# EasyEDA Pro project kuafu01_030内部老化方案.eprj, board PCB4 (continued)
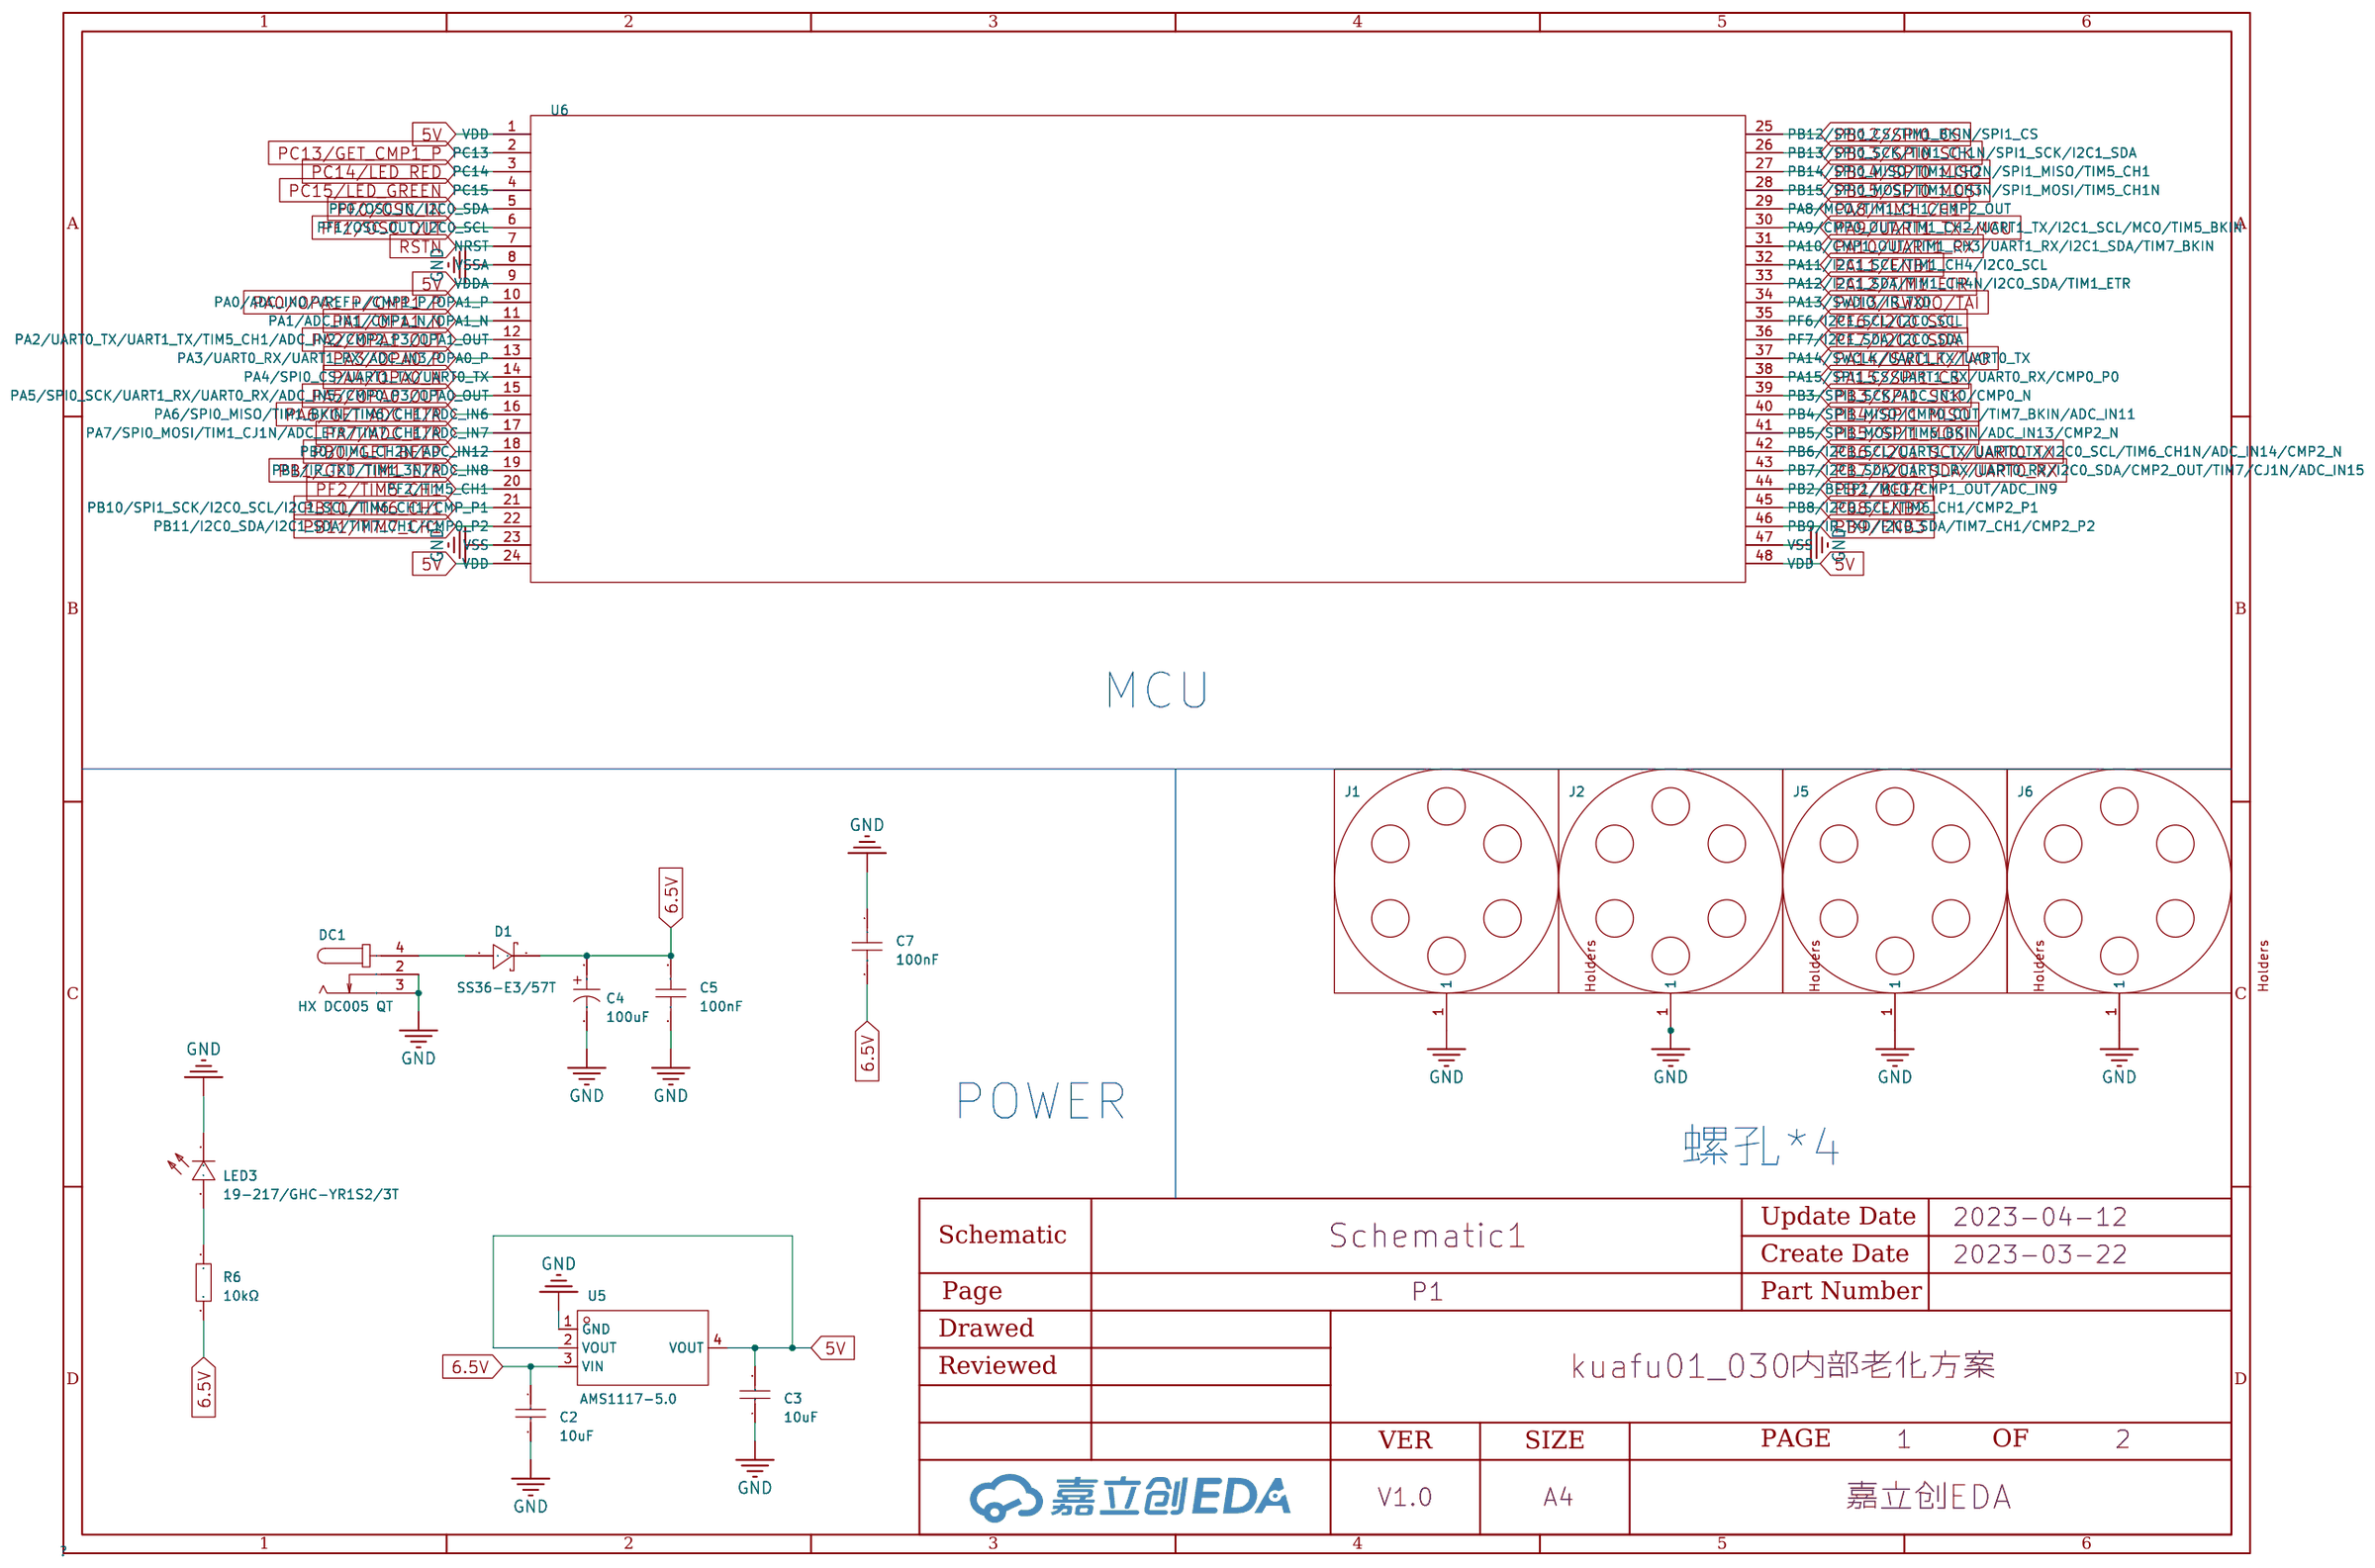
[diagram p0: P1]
## Routing (per net, layer and track width the routed paths; a pad name or vN(x,y) marks a point on that pad's centre or on a via; arc(x,y) is an arc through that point) (continued)
PB14/SPI0_MISO: length 1469.7
  Top Layer w0.254: 256.08,285.12 256.08,286.77 257.84,288.52 265.67,288.52 266.86,289.72 v1(267.56,289.72) ; v1(267.56,238.92) 266.86,238.92 265.67,237.72 257.84,237.72 256.08,235.97 256.08,234.32 ; 56.27,75.81 65.53,75.81 v1(67.19,77.47) ; v1(168.79,229.87) 167.13,228.21 157.87,228.21 ; 56.27,177.41 65.53,177.41 v1(67.19,179.07) ; v1(115.16,238.92) 114.46,238.92 113.27,237.72 105.44,237.72 103.68,235.97 103.68,234.32 ; 205.28,335.92 205.28,337.57 207.04,339.32 214.87,339.32 216.06,340.52 v1(216.76,340.52) ; v1(117.99,128.27) 116.33,126.61 107.07,126.61 ; 208.67,126.61 217.93,126.61 v1(219.59,128.27) ; 205.28,234.32 205.28,235.97 207.04,237.72 214.87,237.72 216.06,238.92 v1(216.76,238.92) ; 208.67,329.81 217.93,329.81 v1(219.59,331.47) ; 103.68,31.12 103.68,32.77 105.44,34.52 113.27,34.52 114.46,35.72 v1(115.16,35.72) ; v1(267.56,188.12) 266.86,188.12 265.67,186.92 257.84,186.92 256.08,185.17 256.08,183.52 ; 56.27,126.61 65.53,126.61 v1(67.19,128.27) ; v1(115.16,188.12) 114.46,188.12 113.27,186.92 105.44,186.92 103.68,185.17 103.68,183.52 ; v1(117.99,179.07) 116.33,177.41 107.07,177.41 ; v1(67.19,280.67) 65.53,279.01 56.27,279.01 ; 306.88,132.72 306.88,134.37 308.64,136.12 316.47,136.12 317.66,137.32 v1(318.36,137.32) ; v1(267.56,137.32) 266.86,137.32 265.67,136.12 257.84,136.12 256.08,134.37 256.08,132.72 ; v1(321.19,128.27) 319.53,126.61 310.27,126.61 ; 107.07,279.01 116.33,279.01 v1(117.99,280.67) ; 259.47,126.61 268.73,126.61 v1(270.39,128.27) ; v1(165.96,340.52) 165.26,340.52 164.07,339.32 156.24,339.32 154.48,337.57 154.48,335.92 ; v1(117.99,229.87) 116.33,228.21 107.07,228.21 ; 306.88,335.92 306.88,337.57 308.64,339.32 316.47,339.32 317.66,340.52 v1(318.36,340.52) ; v1(64.36,289.72) 63.66,289.72 62.47,288.52 54.64,288.52 52.88,286.77 52.88,285.12 ; v1(117.99,26.67) 116.33,25.01 107.07,25.01 ; 208.67,228.21 217.93,228.21 v1(219.59,229.87) ; v1(67.19,229.87) 65.53,228.21 56.27,228.21 ; 259.47,228.21 268.73,228.21 v1(270.39,229.87) ; v1(168.79,128.27) 167.13,126.61 157.87,126.61 ; 154.48,183.52 154.48,185.17 156.24,186.92 164.07,186.92 165.26,188.12 v1(165.96,188.12) ; v1(168.79,280.67) 167.13,279.01 157.87,279.01 ; 103.68,132.72 103.68,134.37 105.44,136.12 113.27,136.12 114.46,137.32 v1(115.16,137.32) ; 306.88,285.12 306.88,286.77 308.64,288.52 316.47,288.52 317.66,289.72 v1(318.36,289.72) ; v1(216.76,137.32) 216.06,137.32 214.87,136.12 207.04,136.12 205.28,134.37 205.28,132.72 ; 52.88,132.72 52.88,134.37 54.64,136.12 62.47,136.12 63.66,137.32 v1(64.36,137.32) ; 259.47,329.81 268.73,329.81 v1(270.39,331.47) ; 259.47,25.01 268.73,25.01 v1(270.39,26.67) ; 157.87,75.81 167.13,75.81 v1(168.79,77.47) ; v1(115.16,340.52) 114.46,340.52 113.27,339.32 105.44,339.32 103.68,337.57 103.68,335.92 ; v1(117.99,331.47) 116.33,329.81 107.07,329.81 ; 157.87,329.81 167.13,329.81 v1(168.79,331.47) ; 256.08,81.92 256.08,83.57 257.84,85.32 265.67,85.32 266.86,86.52 v1(267.56,86.52) ; v1(216.76,86.52) 216.06,86.52 214.87,85.32 207.04,85.32 205.28,83.57 205.28,81.92 ; v1(168.79,179.07) 167.13,177.41 157.87,177.41 ; 256.08,335.92 256.08,337.57 257.84,339.32 265.67,339.32 266.86,340.52 v1(267.56,340.52) ; v1(216.76,289.72) 216.06,289.72 214.87,288.52 207.04,288.52 205.28,286.77 205.28,285.12 ; 310.27,279.01 319.53,279.01 v1(321.19,280.67) ; 157.87,25.01 167.13,25.01 v1(168.79,26.67) ; v1(64.36,238.92) 63.66,238.92 62.47,237.72 54.64,237.72 52.88,235.97 52.88,234.32 ; 154.48,132.72 154.48,134.37 156.24,136.12 164.07,136.12 165.26,137.32 v1(165.96,137.32) ; v1(67.19,26.67) 65.53,25.01 56.27,25.01 ; 256.08,31.12 256.08,32.77 257.84,34.52 265.67,34.52 266.86,35.72 v1(267.56,35.72) ; 310.27,75.81 319.53,75.81 v1(321.19,77.47) ; v1(64.36,86.52) 63.66,86.52 62.47,85.32 54.64,85.32 52.88,83.57 52.88,81.92 ; 259.47,75.81 268.73,75.81 v1(270.39,77.47) ; 208.67,177.41 217.93,177.41 v1(219.59,179.07) ; 107.07,75.81 116.33,75.81 v1(117.99,77.47) ; v1(318.36,86.52) 317.66,86.52 316.47,85.32 308.64,85.32 306.88,83.57 306.88,81.92 ; 154.48,234.32 154.48,235.97 156.24,237.72 164.07,237.72 165.26,238.92 v1(165.96,238.92) ; v1(219.59,26.67) 217.93,25.01 208.67,25.01 ; v1(318.36,238.92) 317.66,238.92 316.47,237.72 308.64,237.72 306.88,235.97 306.88,234.32 ; v1(219.59,77.47) 217.93,75.81 208.67,75.81 ; v1(165.96,289.72) 165.26,289.72 164.07,288.52 156.24,288.52 154.48,286.77 154.48,285.12 ; 310.27,177.41 319.53,177.41 v1(321.19,179.07) ; v1(216.76,35.72) 216.06,35.72 214.87,34.52 207.04,34.52 205.28,32.77 205.28,31.12 ; 52.88,183.52 52.88,185.17 54.64,186.92 62.47,186.92 63.66,188.12 v1(64.36,188.12) ; 310.27,228.21 319.53,228.21 v1(321.19,229.87) ; 154.48,81.92 154.48,83.57 156.24,85.32 164.07,85.32 165.26,86.52 v1(165.96,86.52) ; 205.28,183.52 205.28,185.17 207.04,186.92 214.87,186.92 216.06,188.12 v1(216.76,188.12) ; 306.88,183.52 306.88,185.17 308.64,186.92 316.47,186.92 317.66,188.12 v1(318.36,188.12) ; v1(321.19,331.47) 319.53,329.81 310.27,329.81 ; 259.47,279.01 268.73,279.01 v1(270.39,280.67) ; v1(64.36,35.72) 63.66,35.72 62.47,34.52 54.64,34.52 52.88,32.77 52.88,31.12 ; v1(219.59,280.67) 217.93,279.01 208.67,279.01 ; v1(165.96,35.72) 165.26,35.72 164.07,34.52 156.24,34.52 154.48,32.77 154.48,31.12 ; v1(115.16,86.52) 114.46,86.52 113.27,85.32 105.44,85.32 103.68,83.57 103.68,81.92 ; v1(115.16,289.72) 114.46,289.72 113.27,288.52 105.44,288.52 103.68,286.77 103.68,285.12 ; v1(270.39,179.07) 268.73,177.41 259.47,177.41
  Bottom Layer w0.254: v1(219.59,229.87) 219.85,230.12 219.85,236.44 217.37,238.92 v1(216.76,238.92) ; v1(267.56,188.12) 268.17,188.12 270.65,185.64 270.65,179.32 v1(270.39,179.07) ; v1(270.39,229.87) 270.65,230.12 270.65,236.44 268.17,238.92 v1(267.56,238.92) ; v1(64.36,238.92) 64.97,238.92 67.45,236.44 67.45,230.12 v1(67.19,229.87) ; v1(216.76,137.32) 217.37,137.32 219.85,134.84 219.85,128.52 v1(219.59,128.27) ; v1(216.76,340.52) 217.37,340.52 219.85,338.04 219.85,331.72 v1(219.59,331.47) ; v1(117.99,77.47) 118.25,77.72 118.25,84.04 115.77,86.52 v1(115.16,86.52) ; v1(321.19,229.87) 321.45,230.12 321.45,236.44 318.97,238.92 v1(318.36,238.92) ; v1(219.59,280.67) 219.85,280.92 219.85,287.24 217.37,289.72 v1(216.76,289.72) ; v1(270.39,77.47) 270.65,77.72 270.65,84.04 268.17,86.52 v1(267.56,86.52) ; v1(165.96,35.72) 166.57,35.72 169.05,33.24 169.05,26.92 v1(168.79,26.67) ; v1(117.99,229.87) 118.25,230.12 118.25,236.44 115.77,238.92 v1(115.16,238.92) ; v1(115.16,289.72) 115.77,289.72 118.25,287.24 118.25,280.92 v1(117.99,280.67) ; v1(219.59,77.47) 219.85,77.72 219.85,84.04 217.37,86.52 v1(216.76,86.52) ; v1(67.19,179.07) 67.45,179.32 67.45,185.64 64.97,188.12 v1(64.36,188.12) ; v1(270.39,331.47) 270.65,331.72 270.65,338.04 268.17,340.52 v1(267.56,340.52) ; v1(165.96,137.32) 166.57,137.32 169.05,134.84 169.05,128.52 v1(168.79,128.27) ; v1(64.36,137.32) 64.97,137.32 67.45,134.84 67.45,128.52 v1(67.19,128.27) ; v1(168.79,229.87) 169.05,230.12 169.05,236.44 166.57,238.92 v1(165.96,238.92) ; v1(67.19,77.47) 67.45,77.72 67.45,84.04 64.97,86.52 v1(64.36,86.52) ; v1(219.59,26.67) 219.85,26.92 219.85,33.24 217.37,35.72 v1(216.76,35.72) ; v1(270.39,128.27) 270.65,128.52 270.65,134.84 268.17,137.32 v1(267.56,137.32) ; v1(318.36,86.52) 318.97,86.52 321.45,84.04 321.45,77.72 v1(321.19,77.47) ; v1(321.19,331.47) 321.45,331.72 321.45,338.04 318.97,340.52 v1(318.36,340.52) ; v1(117.99,128.27) 118.25,128.52 118.25,134.84 115.77,137.32 v1(115.16,137.32) ; v1(115.16,340.52) 115.77,340.52 118.25,338.04 118.25,331.72 v1(117.99,331.47) ; v1(168.79,280.67) 169.05,280.92 169.05,287.24 166.57,289.72 v1(165.96,289.72) ; v1(67.19,280.67) 67.45,280.92 67.45,287.24 64.97,289.72 v1(64.36,289.72) ; v1(168.79,179.07) 169.05,179.32 169.05,185.64 166.57,188.12 v1(165.96,188.12) ; v1(117.99,179.07) 118.25,179.32 118.25,185.64 115.77,188.12 v1(115.16,188.12) ; v1(321.19,128.27) 321.45,128.52 321.45,134.84 318.97,137.32 v1(318.36,137.32) ; v1(219.59,179.07) 219.85,179.32 219.85,185.64 217.37,188.12 v1(216.76,188.12) ; v1(64.36,35.72) 64.97,35.72 67.45,33.24 67.45,26.92 v1(67.19,26.67) ; v1(165.96,86.52) 166.57,86.52 169.05,84.04 169.05,77.72 v1(168.79,77.47) ; v1(117.99,26.67) 118.25,26.92 118.25,33.24 115.77,35.72 v1(115.16,35.72) ; v1(165.96,340.52) 166.57,340.52 169.05,338.04 169.05,331.72 v1(168.79,331.47) ; v1(318.36,188.12) 318.97,188.12 321.45,185.64 321.45,179.32 v1(321.19,179.07) ; v1(267.56,289.72) 268.17,289.72 270.65,287.24 270.65,280.92 v1(270.39,280.67) ; v1(267.56,35.72) 268.17,35.72 270.65,33.24 270.65,26.92 v1(270.39,26.67) ; v1(321.19,280.67) 321.45,280.92 321.45,287.24 318.97,289.72 v1(318.36,289.72)
PB15/SPI0_MOSI: length 1402.3
  Top Layer w0.254: 52.36,132.87 52.36,134.41 54.64,136.7 60.54,136.7 61.21,137.37 v1(62.56,137.37) ; v1(316.56,340.57) 315.21,340.57 314.54,339.9 308.64,339.9 306.36,337.61 306.36,336.07 ; v1(218.98,230.51) 218.98,230.25 217.43,228.7 208.24,228.7 ; v1(265.76,188.17) 264.41,188.17 263.74,187.5 257.84,187.5 255.56,185.21 255.56,183.67 ; 255.56,285.27 255.56,286.81 257.84,289.1 263.74,289.1 264.41,289.77 v1(265.76,289.77) ; 204.76,132.87 204.76,134.41 207.04,136.7 212.94,136.7 213.61,137.37 v1(214.96,137.37) ; v1(320.58,128.91) 320.58,128.65 319.03,127.1 309.84,127.1 ; 204.76,285.27 204.76,286.81 207.04,289.1 212.94,289.1 213.61,289.77 v1(214.96,289.77) ; v1(164.16,238.97) 162.81,238.97 162.14,238.3 156.24,238.3 153.96,236.01 153.96,234.47 ; v1(269.78,281.31) 269.78,281.05 268.23,279.5 259.04,279.5 ; 255.56,336.07 255.56,337.61 257.84,339.9 263.74,339.9 264.41,340.57 v1(265.76,340.57) ; 157.44,177.9 166.63,177.9 168.18,179.45 v1(168.18,179.71) ; v1(113.36,238.97) 112.01,238.97 111.34,238.3 105.44,238.3 103.16,236.01 103.16,234.47 ; v1(269.78,27.31) 269.78,27.05 268.23,25.5 259.04,25.5 ; v1(117.38,332.11) 117.38,331.85 115.83,330.3 106.64,330.3 ; v1(62.56,86.57) 61.21,86.57 60.54,85.9 54.64,85.9 52.36,83.61 52.36,82.07 ; 204.76,183.67 204.76,185.21 207.04,187.5 212.94,187.5 213.61,188.17 v1(214.96,188.17) ; 259.04,177.9 268.23,177.9 269.78,179.45 v1(269.78,179.71) ; 106.64,76.3 115.83,76.3 117.38,77.85 v1(117.38,78.11) ; v1(66.58,230.51) 66.58,230.25 65.03,228.7 55.84,228.7 ; 309.84,177.9 319.03,177.9 320.58,179.45 v1(320.58,179.71) ; 103.16,285.27 103.16,286.81 105.44,289.1 111.34,289.1 112.01,289.77 v1(113.36,289.77) ; 153.96,285.27 153.96,286.81 156.24,289.1 162.14,289.1 162.81,289.77 v1(164.16,289.77) ; 55.84,76.3 65.03,76.3 66.58,77.85 v1(66.58,78.11) ; 103.16,183.67 103.16,185.21 105.44,187.5 111.34,187.5 112.01,188.17 v1(113.36,188.17) ; v1(269.78,128.91) 269.78,128.65 268.23,127.1 259.04,127.1 ; 204.76,82.07 204.76,83.61 207.04,85.9 212.94,85.9 213.61,86.57 v1(214.96,86.57) ; 103.16,336.07 103.16,337.61 105.44,339.9 111.34,339.9 112.01,340.57 v1(113.36,340.57) ; v1(218.98,281.31) 218.98,281.05 217.43,279.5 208.24,279.5 ; v1(117.38,128.91) 117.38,128.65 115.83,127.1 106.64,127.1 ; 55.84,25.5 65.03,25.5 66.58,27.05 v1(66.58,27.31) ; 208.24,330.3 217.43,330.3 218.98,331.85 v1(218.98,332.11) ; v1(316.56,238.97) 315.21,238.97 314.54,238.3 308.64,238.3 306.36,236.01 306.36,234.47 ; v1(218.98,27.31) 218.98,27.05 217.43,25.5 208.24,25.5 ; v1(62.56,238.97) 61.21,238.97 60.54,238.3 54.64,238.3 52.36,236.01 52.36,234.47 ; 157.44,76.3 166.63,76.3 168.18,77.85 v1(168.18,78.11) ; 309.84,330.3 319.03,330.3 320.58,331.85 v1(320.58,332.11) ; v1(265.76,238.97) 264.41,238.97 263.74,238.3 257.84,238.3 255.56,236.01 255.56,234.47 ; 309.84,228.7 319.03,228.7 320.58,230.25 v1(320.58,230.51) ; 106.64,177.9 115.83,177.9 117.38,179.45 v1(117.38,179.71) ; v1(66.58,128.91) 66.58,128.65 65.03,127.1 55.84,127.1 ; v1(218.98,128.91) 218.98,128.65 217.43,127.1 208.24,127.1 ; 157.44,228.7 166.63,228.7 168.18,230.25 v1(168.18,230.51) ; v1(269.78,78.11) 269.78,77.85 268.23,76.3 259.04,76.3 ; 52.36,31.27 52.36,32.81 54.64,35.1 60.54,35.1 61.21,35.77 v1(62.56,35.77) ; 103.16,132.87 103.16,134.41 105.44,136.7 111.34,136.7 112.01,137.37 v1(113.36,137.37) ; 204.76,336.07 204.76,337.61 207.04,339.9 212.94,339.9 213.61,340.57 v1(214.96,340.57) ; v1(117.38,281.31) 117.38,281.05 115.83,279.5 106.64,279.5 ; 103.16,31.27 103.16,32.81 105.44,35.1 111.34,35.1 112.01,35.77 v1(113.36,35.77) ; v1(316.56,86.57) 315.21,86.57 314.54,85.9 308.64,85.9 306.36,83.61 306.36,82.07 ; v1(269.78,332.11) 269.78,331.85 268.23,330.3 259.04,330.3 ; v1(316.56,188.17) 315.21,188.17 314.54,187.5 308.64,187.5 306.36,185.21 306.36,183.67 ; v1(117.38,27.31) 117.38,27.05 115.83,25.5 106.64,25.5 ; v1(168.18,128.91) 168.18,128.65 166.63,127.1 157.44,127.1 ; v1(117.38,230.51) 117.38,230.25 115.83,228.7 106.64,228.7 ; v1(62.56,188.17) 61.21,188.17 60.54,187.5 54.64,187.5 52.36,185.21 52.36,183.67 ; 55.84,279.5 65.03,279.5 66.58,281.05 v1(66.58,281.31) ; 157.44,279.5 166.63,279.5 168.18,281.05 v1(168.18,281.31) ; 255.56,82.07 255.56,83.61 257.84,85.9 263.74,85.9 264.41,86.57 v1(265.76,86.57) ; v1(214.96,238.97) 213.61,238.97 212.94,238.3 207.04,238.3 204.76,236.01 204.76,234.47 ; 259.04,228.7 268.23,228.7 269.78,230.25 v1(269.78,230.51) ; v1(218.98,179.71) 218.98,179.45 217.43,177.9 208.24,177.9 ; v1(164.16,86.57) 162.81,86.57 162.14,85.9 156.24,85.9 153.96,83.61 153.96,82.07 ; v1(214.96,35.77) 213.61,35.77 212.94,35.1 207.04,35.1 204.76,32.81 204.76,31.27 ; 52.36,285.27 52.36,286.81 54.64,289.1 60.54,289.1 61.21,289.77 v1(62.56,289.77) ; v1(164.16,35.77) 162.81,35.77 162.14,35.1 156.24,35.1 153.96,32.81 153.96,31.27 ; 309.84,279.5 319.03,279.5 320.58,281.05 v1(320.58,281.31) ; v1(316.56,289.77) 315.21,289.77 314.54,289.1 308.64,289.1 306.36,286.81 306.36,285.27 ; 153.96,132.87 153.96,134.41 156.24,136.7 162.14,136.7 162.81,137.37 v1(164.16,137.37) ; 103.16,82.07 103.16,83.61 105.44,85.9 111.34,85.9 112.01,86.57 v1(113.36,86.57) ; 153.96,183.67 153.96,185.21 156.24,187.5 162.14,187.5 162.81,188.17 v1(164.16,188.17) ; v1(218.98,78.11) 218.98,77.85 217.43,76.3 208.24,76.3 ; v1(320.58,78.11) 320.58,77.85 319.03,76.3 309.84,76.3 ; 306.36,132.87 306.36,134.41 308.64,136.7 314.54,136.7 315.21,137.37 v1(316.56,137.37) ; v1(265.76,35.77) 264.41,35.77 263.74,35.1 257.84,35.1 255.56,32.81 255.56,31.27 ; v1(265.76,137.37) 264.41,137.37 263.74,136.7 257.84,136.7 255.56,134.41 255.56,132.87 ; 55.84,177.9 65.03,177.9 66.58,179.45 v1(66.58,179.71) ; v1(168.18,27.31) 168.18,27.05 166.63,25.5 157.44,25.5 ; 157.44,330.3 166.63,330.3 168.18,331.85 v1(168.18,332.11) ; v1(164.16,340.57) 162.81,340.57 162.14,339.9 156.24,339.9 153.96,337.61 153.96,336.07
  Bottom Layer w0.254: v1(316.56,188.17) 317.11,188.17 320.55,184.73 320.55,179.73 v1(320.58,179.71) ; v1(316.56,340.57) 317.11,340.57 320.55,337.13 320.55,332.13 v1(320.58,332.11) ; v1(218.98,281.31) 218.95,281.33 218.95,286.33 215.51,289.77 v1(214.96,289.77) ; v1(218.98,230.51) 218.95,230.53 218.95,235.53 215.51,238.97 v1(214.96,238.97) ; v1(265.76,86.57) 266.31,86.57 269.75,83.13 269.75,78.13 v1(269.78,78.11) ; v1(269.78,27.31) 269.75,27.33 269.75,32.33 266.31,35.77 v1(265.76,35.77) ; v1(316.56,86.57) 317.11,86.57 320.55,83.13 320.55,78.13 v1(320.58,78.11) ; v1(265.76,238.97) 266.31,238.97 269.75,235.53 269.75,230.53 v1(269.78,230.51) ; v1(66.58,230.51) 66.55,230.53 66.55,235.53 63.11,238.97 v1(62.56,238.97) ; v1(168.18,27.31) 168.15,27.33 168.15,32.33 164.71,35.77 v1(164.16,35.77) ; v1(316.56,289.77) 317.11,289.77 320.55,286.33 320.55,281.33 v1(320.58,281.31) ; v1(164.16,238.97) 164.71,238.97 168.15,235.53 168.15,230.53 v1(168.18,230.51) ; v1(218.98,78.11) 218.95,78.13 218.95,83.13 215.51,86.57 v1(214.96,86.57) ; v1(269.78,281.31) 269.75,281.33 269.75,286.33 266.31,289.77 v1(265.76,289.77) ; v1(168.18,179.71) 168.15,179.73 168.15,184.73 164.71,188.17 v1(164.16,188.17) ; v1(113.36,137.37) 113.91,137.37 117.35,133.93 117.35,128.93 v1(117.38,128.91) ; v1(320.58,128.91) 320.55,128.93 320.55,133.93 317.11,137.37 v1(316.56,137.37) ; v1(218.98,27.31) 218.95,27.33 218.95,32.33 215.51,35.77 v1(214.96,35.77) ; v1(269.78,332.11) 269.75,332.13 269.75,337.13 266.31,340.57 v1(265.76,340.57) ; v1(113.36,188.17) 113.91,188.17 117.35,184.73 117.35,179.73 v1(117.38,179.71) ; v1(265.76,137.37) 266.31,137.37 269.75,133.93 269.75,128.93 v1(269.78,128.91) ; v1(164.16,137.37) 164.71,137.37 168.15,133.93 168.15,128.93 v1(168.18,128.91) ; v1(164.16,289.77) 164.71,289.77 168.15,286.33 168.15,281.33 v1(168.18,281.31) ; v1(316.56,238.97) 317.11,238.97 320.55,235.53 320.55,230.53 v1(320.58,230.51) ; v1(164.16,86.57) 164.71,86.57 168.15,83.13 168.15,78.13 v1(168.18,78.11) ; v1(117.38,230.51) 117.35,230.53 117.35,235.53 113.91,238.97 v1(113.36,238.97) ; v1(218.98,128.91) 218.95,128.93 218.95,133.93 215.51,137.37 v1(214.96,137.37) ; v1(117.38,78.11) 117.35,78.13 117.35,83.13 113.91,86.57 v1(113.36,86.57) ; v1(113.36,35.77) 113.91,35.77 117.35,32.33 117.35,27.33 v1(117.38,27.31) ; v1(117.38,332.11) 117.35,332.13 117.35,337.13 113.91,340.57 v1(113.36,340.57) ; v1(62.56,188.17) 63.11,188.17 66.55,184.73 66.55,179.73 v1(66.58,179.71) ; v1(66.58,78.11) 66.55,78.13 66.55,83.13 63.11,86.57 v1(62.56,86.57) ; v1(62.56,289.77) 63.11,289.77 66.55,286.33 66.55,281.33 v1(66.58,281.31) ; v1(218.98,179.71) 218.95,179.73 218.95,184.73 215.51,188.17 v1(214.96,188.17) ; v1(164.16,340.57) 164.71,340.57 168.15,337.13 168.15,332.13 v1(168.18,332.11) ; v1(62.56,35.77) 63.11,35.77 66.55,32.33 66.55,27.33 v1(66.58,27.31) ; v1(117.38,281.31) 117.35,281.33 117.35,286.33 113.91,289.77 v1(113.36,289.77) ; v1(218.98,332.11) 218.95,332.13 218.95,337.13 215.51,340.57 v1(214.96,340.57) ; v1(269.78,179.71) 269.75,179.73 269.75,184.73 266.31,188.17 v1(265.76,188.17) ; v1(66.58,128.91) 66.55,128.93 66.55,133.93 63.11,137.37 v1(62.56,137.37)
PC13/GET_CMP1_P: length 1482.3
  Top Layer w0.254: 137.84,222 135.75,222 133.64,224.1 133.64,237.59 134.7,238.65 141.52,238.65 147.97,232.2 U6#5.2 ; 36.24,272.8 34.15,272.8 32.04,274.9 32.04,288.39 33.1,289.45 39.92,289.45 46.36,283 U6#37.2 ; 188.64,272.8 186.55,272.8 184.44,274.9 184.44,288.39 185.5,289.45 192.32,289.45 198.77,283 199.83,283 ; 137.84,272.8 135.75,272.8 133.64,274.9 133.64,288.39 134.7,289.45 141.52,289.45 147.97,283 U6#39.2 ; U6#27.2 46.36,29 39.92,35.45 33.1,35.45 32.04,34.39 32.04,20.9 34.15,18.8 36.24,18.8 ; U6#13.2 249.56,181.4 243.12,187.85 236.3,187.85 235.24,186.79 235.24,173.3 237.35,171.2 239.44,171.2 ; U6#4.2 97.16,232.2 90.72,238.65 83.9,238.65 82.84,237.59 82.84,224.1 84.95,222 87.04,222 ; 239.44,18.8 237.35,18.8 235.24,20.9 235.24,34.39 236.3,35.45 243.12,35.45 249.56,29 U6#31.2 ; 239.44,272.8 237.35,272.8 235.24,274.9 235.24,288.39 236.3,289.45 243.12,289.45 249.56,283 U6.2 ; 290.24,222 288.15,222 286.04,224.1 286.04,237.59 287.1,238.65 293.92,238.65 300.37,232.2 U6#8.2 ; 137.84,120.4 135.75,120.4 133.64,122.5 133.64,135.99 134.7,137.05 141.52,137.05 147.97,130.6 U6#17.2 ; 199.83,181.4 198.77,181.4 192.32,187.85 185.5,187.85 184.44,186.79 184.44,173.3 186.55,171.2 188.64,171.2 ; U6#19.2 249.56,130.6 243.12,137.05 236.3,137.05 235.24,135.99 235.24,122.5 237.35,120.4 239.44,120.4 ; U6#15.2 46.36,130.6 39.92,137.05 33.1,137.05 32.04,135.99 32.04,122.5 34.15,120.4 36.24,120.4 ; U6#38.2 97.16,283 90.72,289.45 83.9,289.45 82.84,288.39 82.84,274.9 84.95,272.8 87.04,272.8 ; U6#20.2 300.37,130.6 293.92,137.05 287.1,137.05 286.04,135.99 286.04,122.5 288.15,120.4 290.24,120.4 ; U6#29.2 147.97,29 141.52,35.45 134.7,35.45 133.64,34.39 133.64,20.9 135.75,18.8 137.84,18.8 ; 290.24,323.6 288.15,323.6 286.04,325.7 286.04,339.19 287.1,340.25 293.92,340.25 300.37,333.8 U6#36.2 ; 137.84,171.2 135.75,171.2 133.64,173.3 133.64,186.79 134.7,187.85 141.52,187.85 147.97,181.4 U6#11.2 ; 239.44,69.6 237.35,69.6 235.24,71.7 235.24,85.19 236.3,86.25 243.12,86.25 249.56,79.8 U6#25.2 ; 239.44,323.6 237.35,323.6 235.24,325.7 235.24,339.19 236.3,340.25 243.12,340.25 249.56,333.8 U6#35.2 ; 87.04,69.6 84.95,69.6 82.84,71.7 82.84,85.19 83.9,86.25 90.72,86.25 97.16,79.8 U6#22.2 ; U6#3.2 46.36,232.2 39.92,238.65 33.1,238.65 32.04,237.59 32.04,224.1 34.15,222 36.24,222 ; 87.04,18.8 84.95,18.8 82.84,20.9 82.84,34.39 83.9,35.45 90.72,35.45 97.16,29 U6#28.2 ; 137.84,69.6 135.75,69.6 133.64,71.7 133.64,85.19 134.7,86.25 141.52,86.25 147.97,79.8 U6#23.2 ; U6#32.2 97.16,333.8 90.72,340.25 83.9,340.25 82.84,339.19 82.84,325.7 84.95,323.6 87.04,323.6 ; U6#16.2 97.16,130.6 90.72,137.05 83.9,137.05 82.84,135.99 82.84,122.5 84.95,120.4 87.04,120.4 ; 290.24,69.6 288.15,69.6 286.04,71.7 286.04,85.19 287.1,86.25 293.92,86.25 300.37,79.8 U6#26.2 ; U6#9.2 46.36,181.4 39.92,187.85 33.1,187.85 32.04,186.79 32.04,173.3 34.15,171.2 36.24,171.2 ; 188.64,69.6 186.55,69.6 184.44,71.7 184.44,85.19 185.5,86.25 192.32,86.25 198.77,79.8 199.83,79.8 ; 137.84,323.6 135.75,323.6 133.64,325.7 133.64,339.19 134.7,340.25 141.52,340.25 147.97,333.8 U6#33.2 ; 199.83,232.2 198.77,232.2 192.32,238.65 185.5,238.65 184.44,237.59 184.44,224.1 186.55,222 188.64,222 ; 290.24,171.2 288.15,171.2 286.04,173.3 286.04,186.79 287.1,187.85 293.92,187.85 300.37,181.4 U6#14.2 ; 36.24,69.6 34.15,69.6 32.04,71.7 32.04,85.19 33.1,86.25 39.92,86.25 46.36,79.8 U6#21.2 ; U6#2.2 300.37,283 293.92,289.45 287.1,289.45 286.04,288.39 286.04,274.9 288.15,272.8 290.24,272.8 ; 188.64,120.4 186.55,120.4 184.44,122.5 184.44,135.99 185.5,137.05 192.32,137.05 198.77,130.6 199.83,130.6 ; U6#7.2 249.56,232.2 243.12,238.65 236.3,238.65 235.24,237.59 235.24,224.1 237.35,222 239.44,222 ; 188.64,323.6 186.55,323.6 184.44,325.7 184.44,339.19 185.5,340.25 192.32,340.25 198.77,333.8 199.83,333.8 ; 188.64,18.8 186.55,18.8 184.44,20.9 184.44,34.39 185.5,35.45 192.32,35.45 198.77,29 199.83,29 ; U6#10.2 97.16,181.4 90.72,187.85 83.9,187.85 82.84,186.79 82.84,173.3 84.95,171.2 87.04,171.2
PC14/LED_RED: length 400.4
  Top Layer w0.254: 47.43,231.7 46.29,231.7 40.55,237.44 39.8,237.44 39.8,237.44 ; 199.83,282.5 198.69,282.5 192.95,288.24 192.2,288.24 192.2,288.25 ; 293.8,288.25 293.8,288.24 294.55,288.24 300.29,282.5 301.43,282.5 ; 250.63,282.5 249.49,282.5 243.75,288.24 243,288.24 243,288.25 ; 98.23,28.5 97.09,28.5 91.35,34.24 90.6,34.24 90.6,34.25 ; 47.43,130.1 46.29,130.1 40.55,135.84 39.8,135.84 39.8,135.84 ; 149.03,79.3 147.89,79.3 142.15,85.04 141.4,85.04 141.4,85.04 ; 192.2,186.64 192.2,186.64 192.95,186.64 198.69,180.9 199.83,180.9 ; 98.23,180.9 97.09,180.9 91.35,186.64 90.6,186.64 90.6,186.64 ; 90.6,85.04 90.6,85.04 91.35,85.04 97.09,79.3 98.23,79.3 ; 39.8,288.25 39.8,288.24 40.55,288.24 46.29,282.5 47.43,282.5 ; 293.8,135.84 293.8,135.84 294.55,135.84 300.29,130.1 301.43,130.1 ; 301.43,333.3 300.29,333.3 294.55,339.04 293.8,339.04 293.8,339.04 ; 250.63,28.5 249.49,28.5 243.75,34.24 243,34.24 243,34.25 ; 47.43,180.9 46.29,180.9 40.55,186.64 39.8,186.64 39.8,186.64 ; 98.23,231.7 97.09,231.7 91.35,237.44 90.6,237.44 90.6,237.44 ; 293.8,186.64 293.8,186.64 294.55,186.64 300.29,180.9 301.43,180.9 ; 141.4,237.44 141.4,237.44 142.15,237.44 147.89,231.7 149.03,231.7 ; 98.23,282.5 97.09,282.5 91.35,288.24 90.6,288.24 90.6,288.25 ; 141.4,288.25 141.4,288.24 142.15,288.24 147.89,282.5 149.03,282.5 ; 293.8,85.04 293.8,85.04 294.55,85.04 300.29,79.3 301.43,79.3 ; 149.03,130.1 147.89,130.1 142.15,135.84 141.4,135.84 141.4,135.84 ; 199.83,231.7 198.69,231.7 192.95,237.44 192.2,237.44 192.2,237.44 ; 250.63,231.7 249.49,231.7 243.75,237.44 243,237.44 243,237.44 ; 199.83,130.1 198.69,130.1 192.95,135.84 192.2,135.84 192.2,135.84 ; 39.8,85.04 39.8,85.04 40.55,85.04 46.29,79.3 47.43,79.3 ; 47.43,28.5 46.29,28.5 40.55,34.24 39.8,34.24 39.8,34.25 ; 149.03,28.5 147.89,28.5 142.15,34.24 141.4,34.24 141.4,34.25 ; 192.2,339.04 192.2,339.04 192.95,339.04 198.69,333.3 199.83,333.3 ; 243,186.64 243,186.64 243.75,186.64 249.49,180.9 250.63,180.9 ; 149.03,180.9 147.89,180.9 142.15,186.64 141.4,186.64 141.4,186.64 ; 149.03,333.3 147.89,333.3 142.15,339.04 141.4,339.04 141.4,339.04 ; 250.63,130.1 249.49,130.1 243.75,135.84 243,135.84 243,135.84 ; 301.43,231.7 300.29,231.7 294.55,237.44 293.8,237.44 293.8,237.44 ; 199.83,28.5 198.69,28.5 192.95,34.24 192.2,34.24 192.2,34.25 ; 250.63,333.3 249.49,333.3 243.75,339.04 243,339.04 243,339.04 ; 98.23,333.3 97.09,333.3 91.35,339.04 90.6,339.04 90.6,339.04 ; 90.6,135.84 90.6,135.84 91.35,135.84 97.09,130.1 98.23,130.1 ; 192.2,85.04 192.2,85.04 192.95,85.04 198.69,79.3 199.83,79.3 ; 243,85.04 243,85.04 243.75,85.04 249.49,79.3 250.63,79.3
PC15/LED_GREEN: length 382.3
  Top Layer w0.254: 250.62,180.41 249.41,180.41 244.94,184.88 242.92,184.88 ; 293.72,235.68 295.74,235.68 300.21,231.21 301.42,231.21 ; 293.72,337.28 295.74,337.28 300.21,332.81 301.42,332.81 ; 90.52,235.68 92.54,235.68 97.01,231.21 98.22,231.21 ; 90.52,337.28 92.54,337.28 97.01,332.81 98.22,332.81 ; 90.52,184.88 92.54,184.88 97.01,180.41 98.22,180.41 ; 250.62,282.01 249.41,282.01 244.94,286.48 242.92,286.48 ; 250.62,78.81 249.41,78.81 244.94,83.28 242.92,83.28 ; 301.42,282.01 300.21,282.01 295.74,286.48 293.72,286.48 ; 47.42,129.61 46.21,129.61 41.74,134.08 39.72,134.08 ; 90.52,83.28 92.54,83.28 97.01,78.81 98.22,78.81 ; 141.32,83.28 143.34,83.28 147.81,78.81 149.02,78.81 ; 149.02,332.81 147.81,332.81 143.34,337.28 141.32,337.28 ; 242.92,32.48 244.94,32.48 249.41,28.01 250.62,28.01 ; 293.72,134.08 295.74,134.08 300.21,129.61 301.42,129.61 ; 199.82,129.61 198.61,129.61 194.14,134.08 192.12,134.08 ; 301.42,180.41 300.21,180.41 295.74,184.88 293.72,184.88 ; 39.72,235.68 41.74,235.68 46.21,231.21 47.42,231.21 ; 192.12,286.48 194.14,286.48 198.61,282.01 199.82,282.01 ; 199.82,231.21 198.61,231.21 194.14,235.68 192.12,235.68 ; 141.32,286.48 143.34,286.48 147.81,282.01 149.02,282.01 ; 293.72,83.28 295.74,83.28 300.21,78.81 301.42,78.81 ; 250.62,231.21 249.41,231.21 244.94,235.68 242.92,235.68 ; 149.02,180.41 147.81,180.41 143.34,184.88 141.32,184.88 ; 149.02,129.61 147.81,129.61 143.34,134.08 141.32,134.08 ; 199.82,332.81 198.61,332.81 194.14,337.28 192.12,337.28 ; 242.92,337.28 244.94,337.28 249.41,332.81 250.62,332.81 ; 192.12,32.48 194.14,32.48 198.61,28.01 199.82,28.01 ; 199.82,180.41 198.61,180.41 194.14,184.88 192.12,184.88 ; 39.72,286.48 41.74,286.48 46.21,282.01 47.42,282.01 ; 149.02,231.21 147.81,231.21 143.34,235.68 141.32,235.68 ; 250.62,129.61 249.41,129.61 244.94,134.08 242.92,134.08 ; 90.52,286.48 92.54,286.48 97.01,282.01 98.22,282.01 ; 47.42,28.01 46.21,28.01 41.74,32.48 39.72,32.48 ; 192.12,83.28 194.14,83.28 198.61,78.81 199.82,78.81 ; 149.02,28.01 147.81,28.01 143.34,32.48 141.32,32.48 ; 90.52,134.08 92.54,134.08 97.01,129.61 98.22,129.61 ; 39.72,83.28 41.74,83.28 46.21,78.81 47.42,78.81 ; 39.72,184.88 41.74,184.88 46.21,180.41 47.42,180.41 ; 90.52,32.48 92.54,32.48 97.01,28.01 98.22,28.01
PF0/OSC_IN: length 419.9
  Top Layer w0.254: 190.35,29.96 190.37,29.94 192.41,29.94 194.85,27.51 199.83,27.51 ; 149.03,129.11 144.05,129.11 141.61,131.54 139.57,131.54 139.55,131.56 ; 98.23,332.31 93.25,332.31 90.81,334.74 88.77,334.74 88.75,334.76 ; 190.35,233.16 190.37,233.14 192.41,233.14 194.85,230.71 199.83,230.71 ; 139.55,283.96 139.57,283.94 141.61,283.94 144.05,281.51 149.03,281.51 ; 250.63,332.31 245.65,332.31 243.21,334.74 241.17,334.74 241.15,334.76 ; 301.43,78.31 296.45,78.31 294.01,80.74 291.97,80.74 291.95,80.76 ; 291.95,131.56 291.97,131.54 294.01,131.54 296.45,129.11 301.43,129.11 ; 88.75,80.76 88.77,80.74 90.81,80.74 93.25,78.31 98.23,78.31 ; 149.03,179.91 144.05,179.91 141.61,182.34 139.57,182.34 139.55,182.36 ; 98.23,179.91 93.25,179.91 90.81,182.34 88.77,182.34 88.75,182.36 ; 291.95,283.96 291.97,283.94 294.01,283.94 296.45,281.51 301.43,281.51 ; 301.43,230.71 296.45,230.71 294.01,233.14 291.97,233.14 291.95,233.16 ; 88.75,283.96 88.77,283.94 90.81,283.94 93.25,281.51 98.23,281.51 ; 250.63,179.91 245.65,179.91 243.21,182.34 241.17,182.34 241.15,182.36 ; 47.43,179.91 42.45,179.91 40.01,182.34 37.97,182.34 37.95,182.36 ; 149.03,230.71 144.05,230.71 141.61,233.14 139.57,233.14 139.55,233.16 ; 47.43,129.11 42.45,129.11 40.01,131.54 37.97,131.54 37.95,131.56 ; 149.03,78.31 144.05,78.31 141.61,80.74 139.57,80.74 139.55,80.76 ; 47.43,78.31 42.45,78.31 40.01,80.74 37.97,80.74 37.95,80.76 ; 37.95,233.16 37.97,233.14 40.01,233.14 42.45,230.71 47.43,230.71 ; 250.63,78.31 245.65,78.31 243.21,80.74 241.17,80.74 241.15,80.76 ; 37.95,29.96 37.97,29.94 40.01,29.94 42.45,27.51 47.43,27.51 ; 199.83,332.31 194.85,332.31 192.41,334.74 190.37,334.74 190.35,334.76 ; 241.15,233.16 241.17,233.14 243.21,233.14 245.65,230.71 250.63,230.71 ; 241.15,131.56 241.17,131.54 243.21,131.54 245.65,129.11 250.63,129.11 ; 250.63,281.51 245.65,281.51 243.21,283.94 241.17,283.94 241.15,283.96 ; 190.35,283.96 190.37,283.94 192.41,283.94 194.85,281.51 199.83,281.51 ; 241.15,29.96 241.17,29.94 243.21,29.94 245.65,27.51 250.63,27.51 ; 98.23,129.11 93.25,129.11 90.81,131.54 88.77,131.54 88.75,131.56 ; 190.35,182.36 190.37,182.34 192.41,182.34 194.85,179.91 199.83,179.91 ; 139.55,29.96 139.57,29.94 141.61,29.94 144.05,27.51 149.03,27.51 ; 190.35,80.76 190.37,80.74 192.41,80.74 194.85,78.31 199.83,78.31 ; 139.55,334.76 139.57,334.74 141.61,334.74 144.05,332.31 149.03,332.31 ; 291.95,334.76 291.97,334.74 294.01,334.74 296.45,332.31 301.43,332.31 ; 190.35,131.56 190.37,131.54 192.41,131.54 194.85,129.11 199.83,129.11 ; 98.23,27.51 93.25,27.51 90.81,29.94 88.77,29.94 88.75,29.96 ; 98.23,230.71 93.25,230.71 90.81,233.14 88.77,233.14 88.75,233.16 ; 37.95,283.96 37.97,283.94 40.01,283.94 42.45,281.51 47.43,281.51 ; 291.95,182.36 291.97,182.34 294.01,182.34 296.45,179.91 301.43,179.91